# EasyEDA Pro project BlueberryPi.eprj, schematic BlueberryPi Board, sheets 9 to 13 of 13

## Sheets
9 eMMC-GPIO: Page Name: eMMC-GPIO; Update Date: 2023-07-05
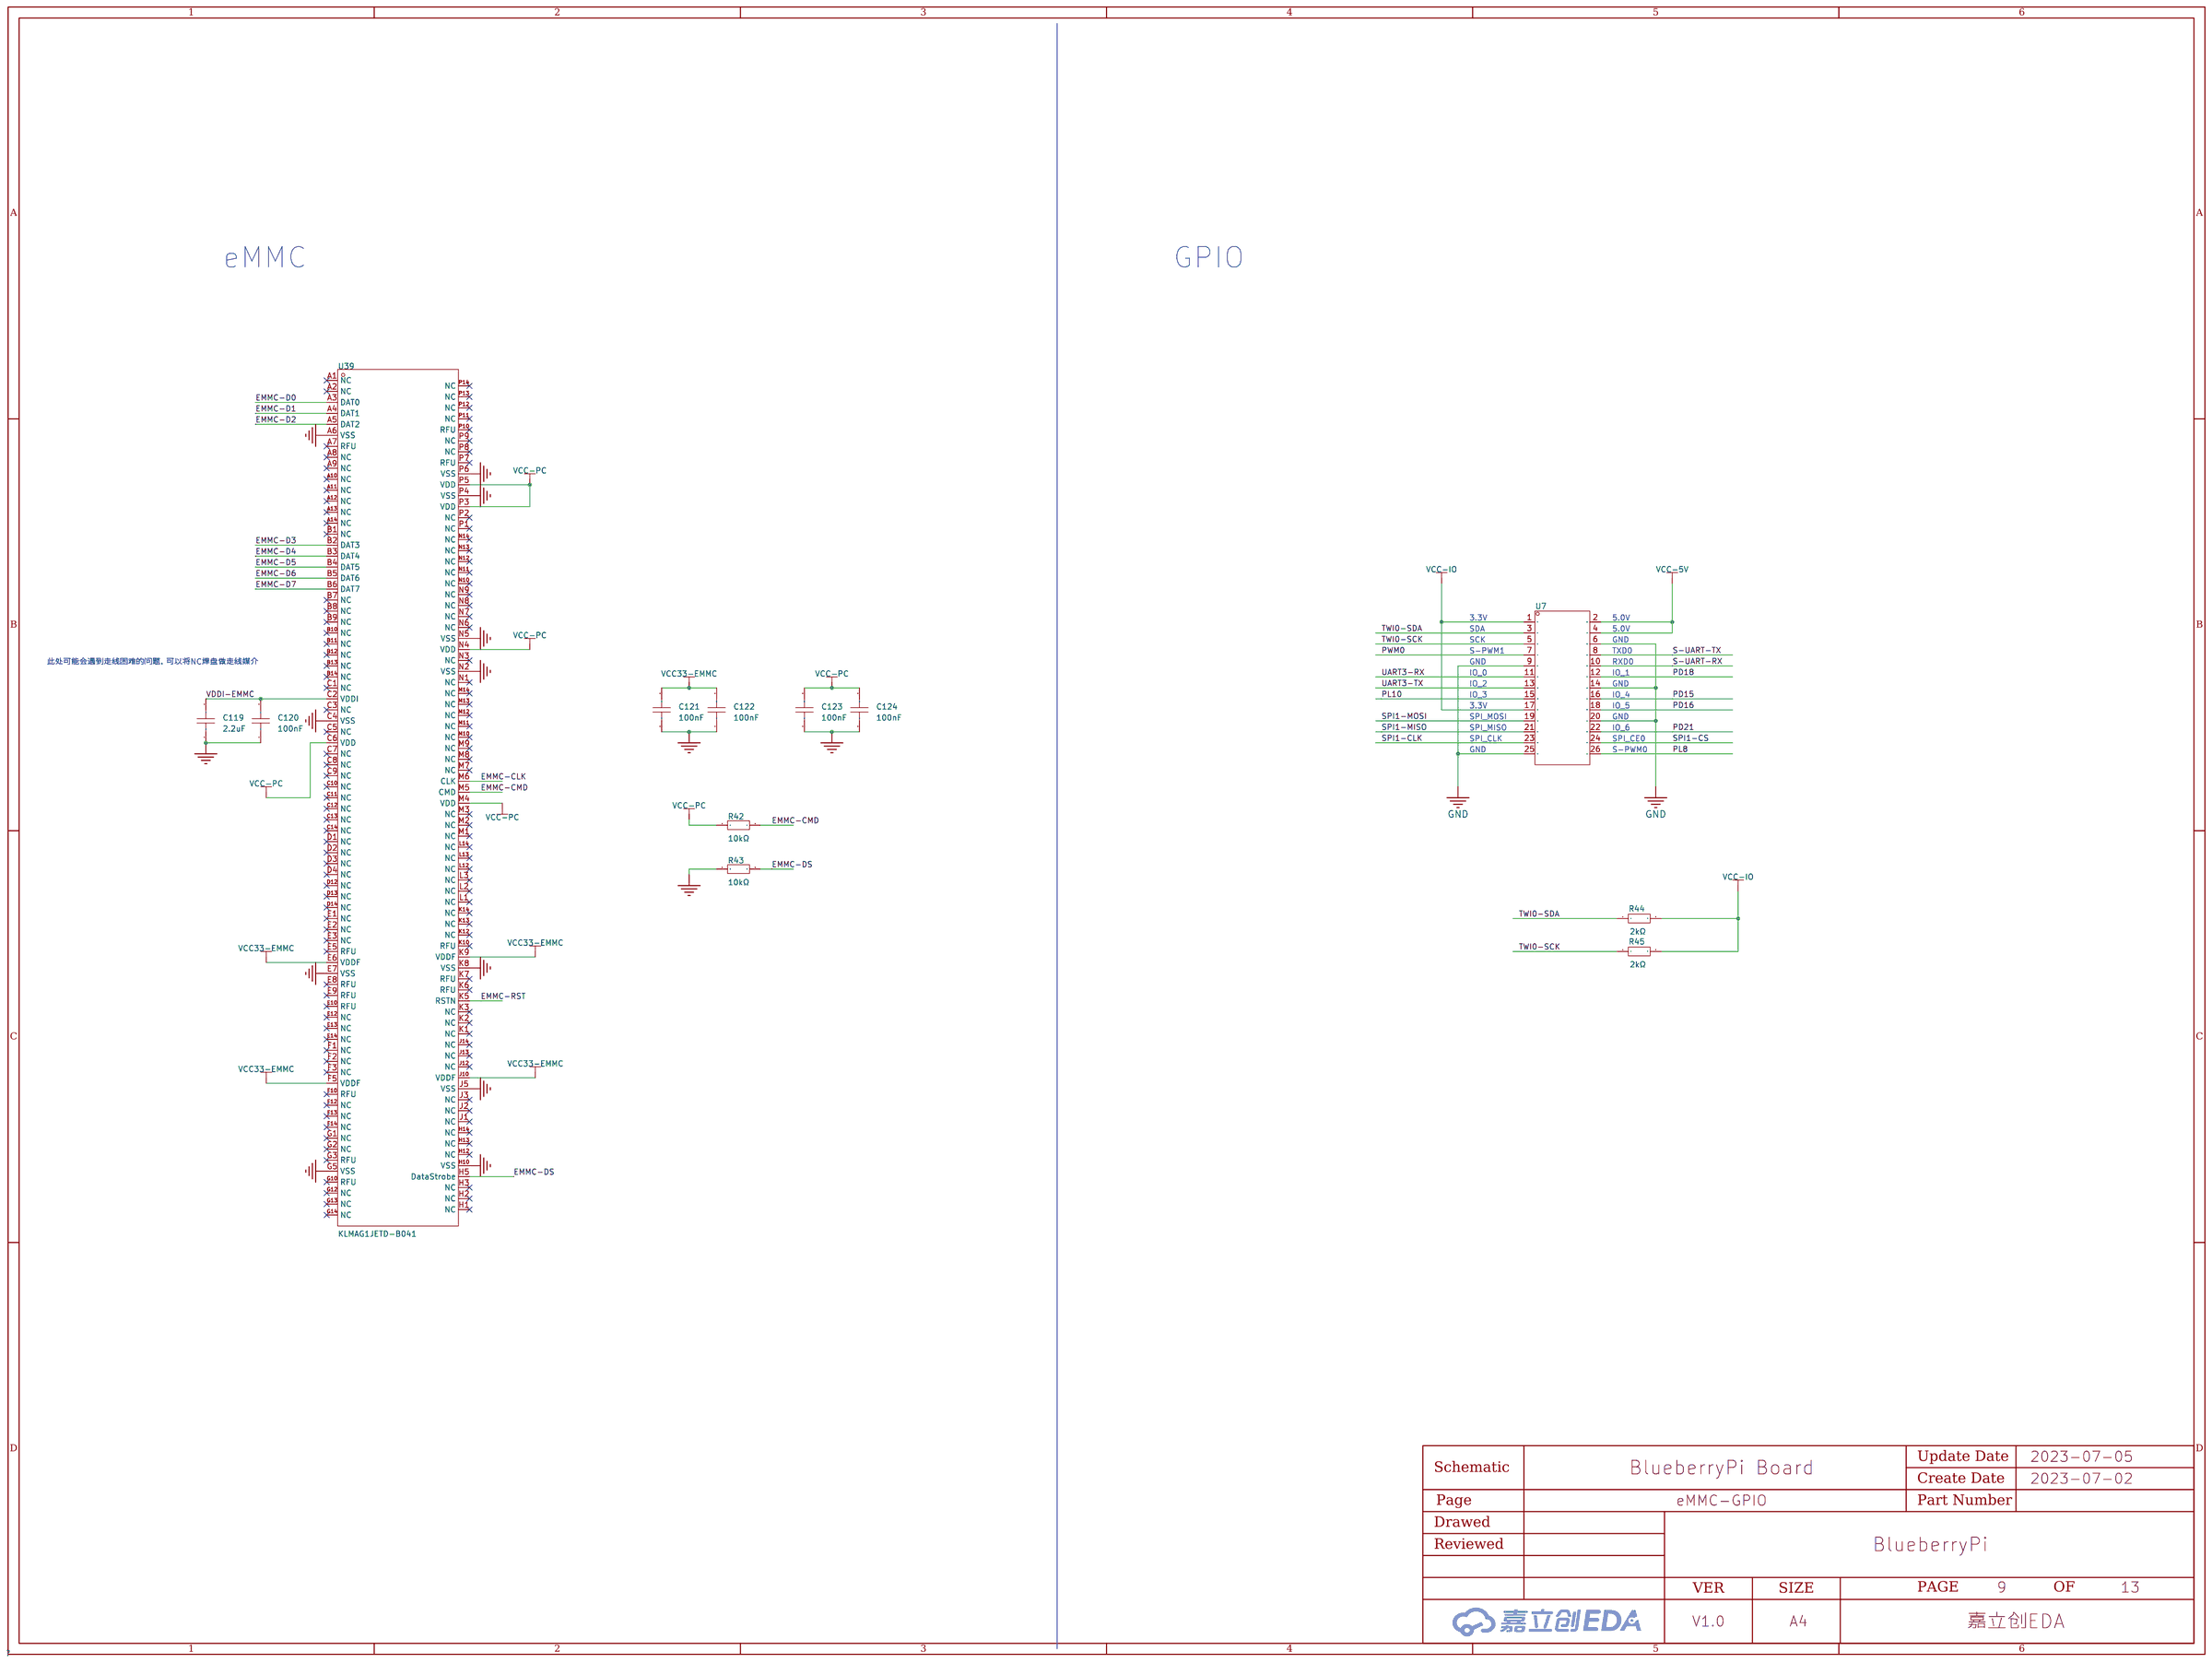
[diagram p8: eMMC-GPIO]
10 CARD-USB: Page Name: CARD-USB; Update Date: 2023-07-06
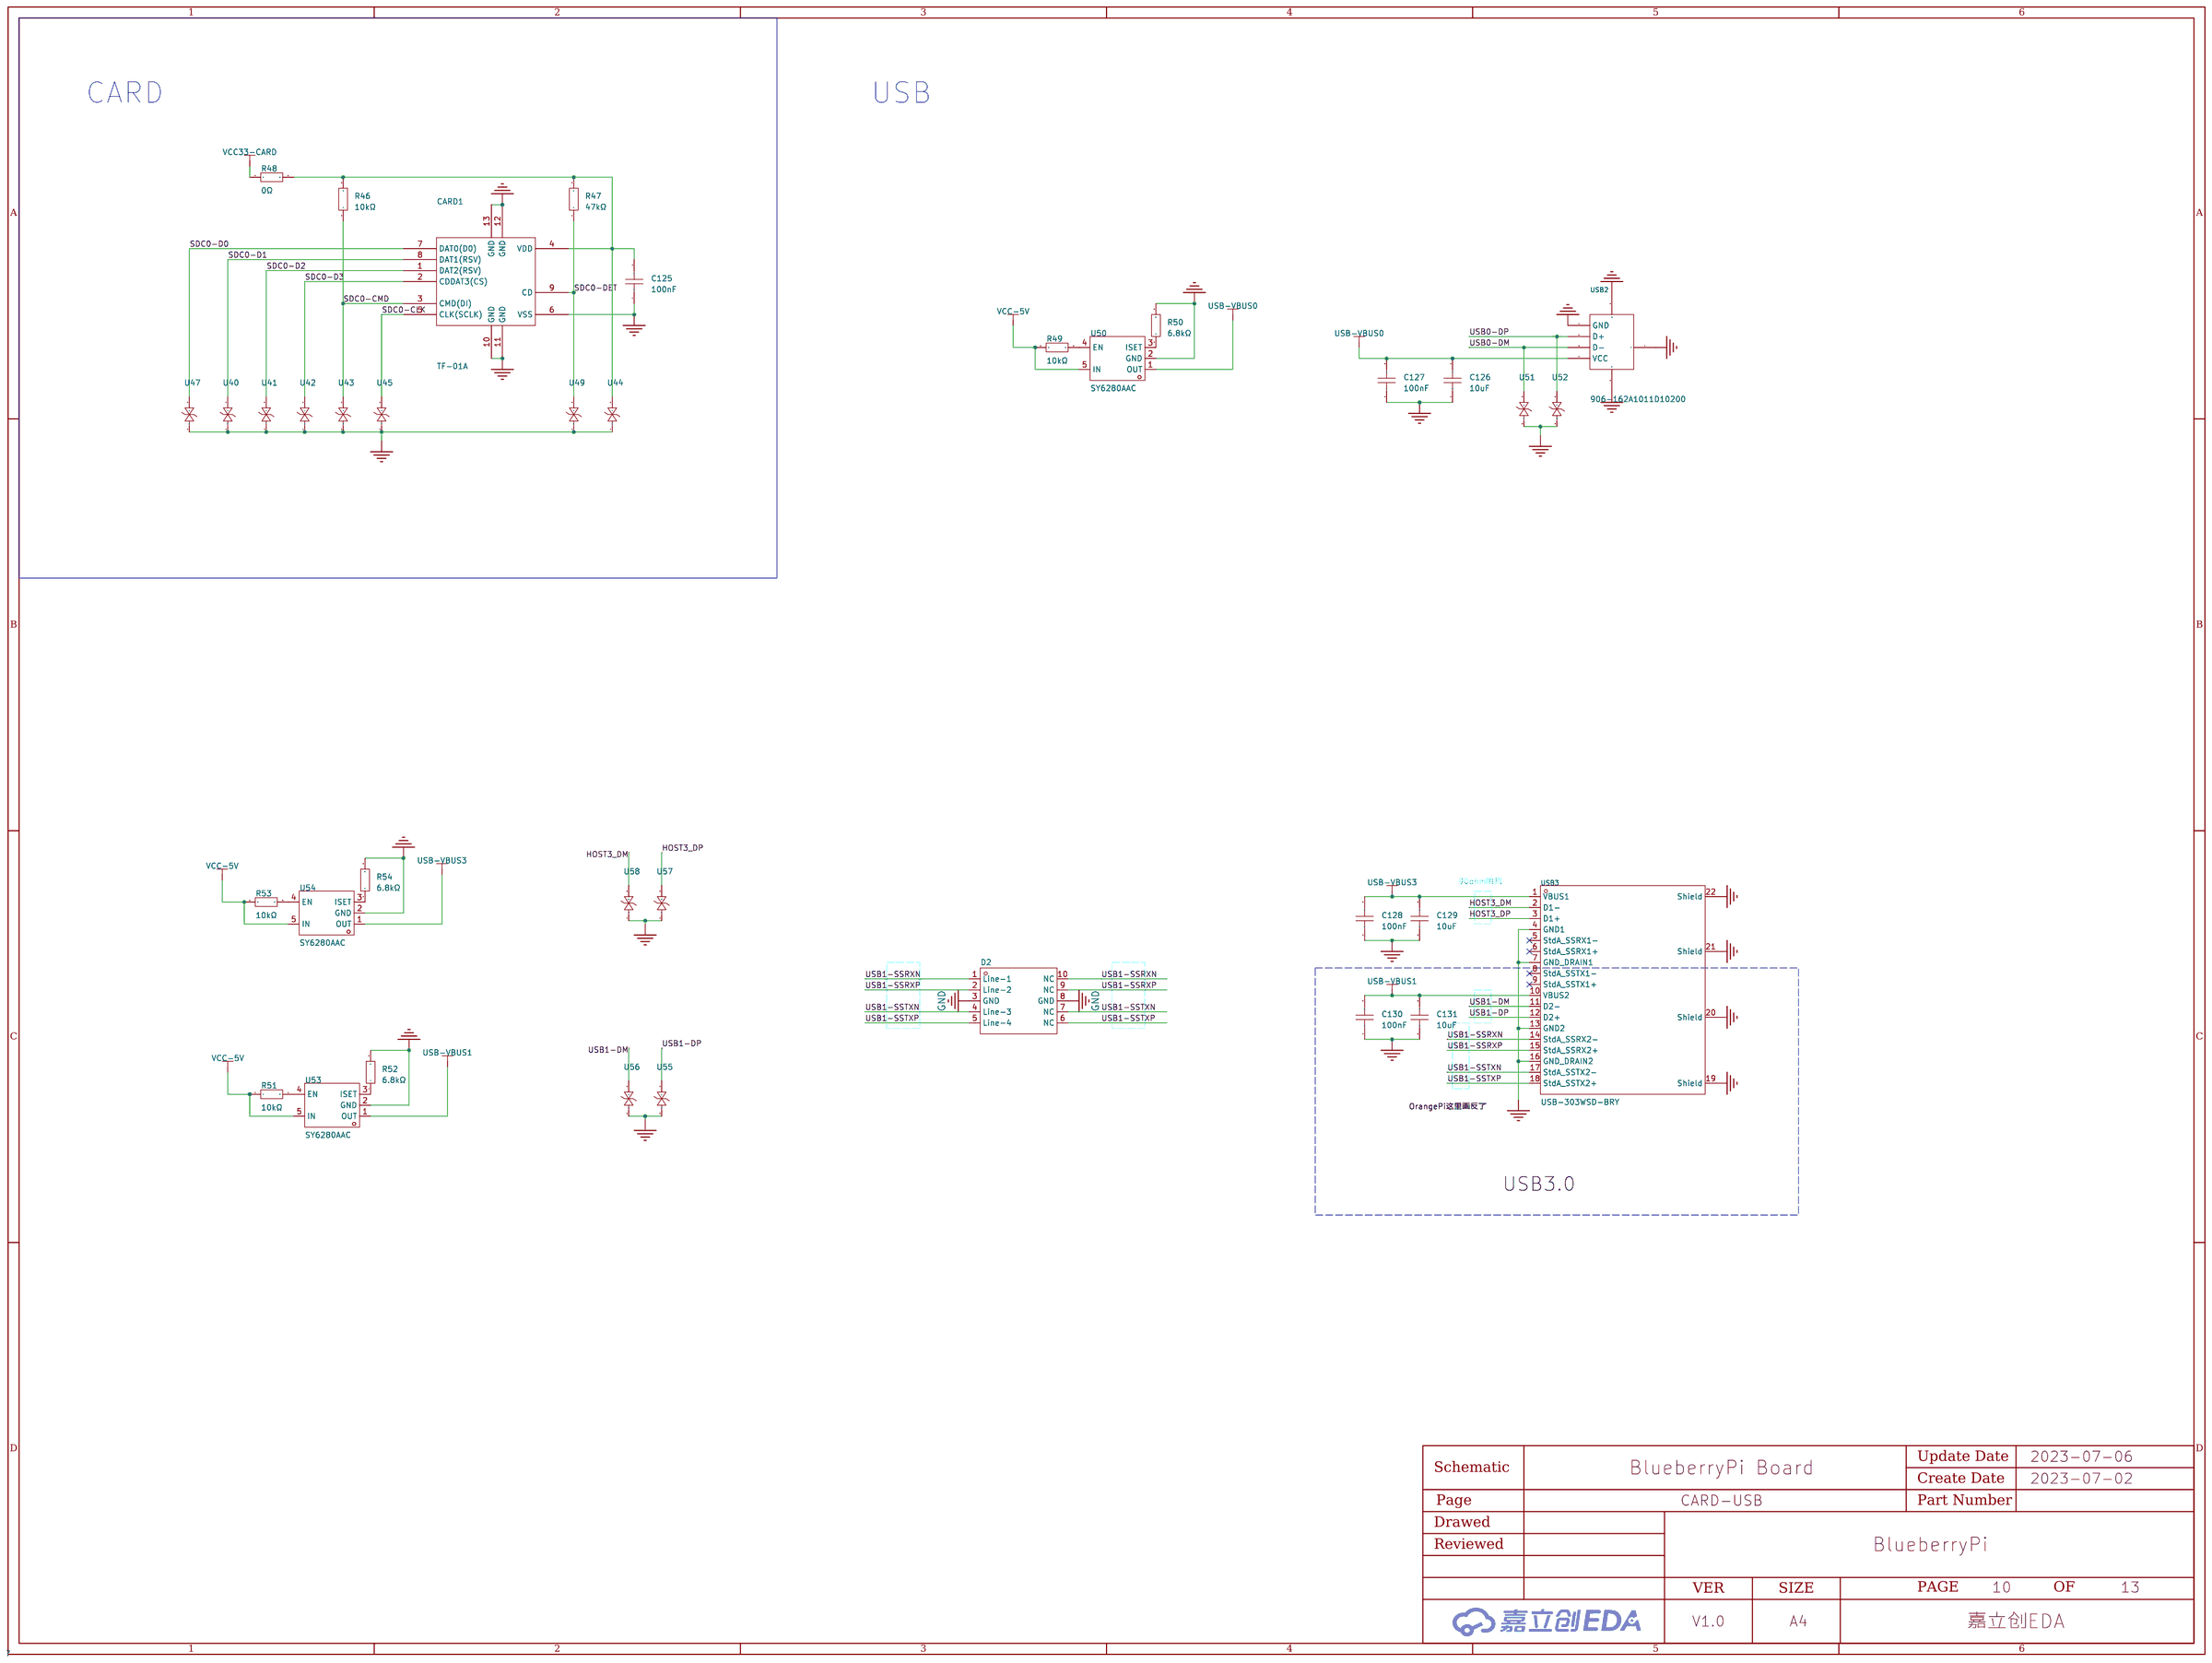
[diagram p9: CARD-USB]
11 KEY-LED-DEBUG: Page Name: KEY-LED-DEBUG; Update Date: 2023-07-07
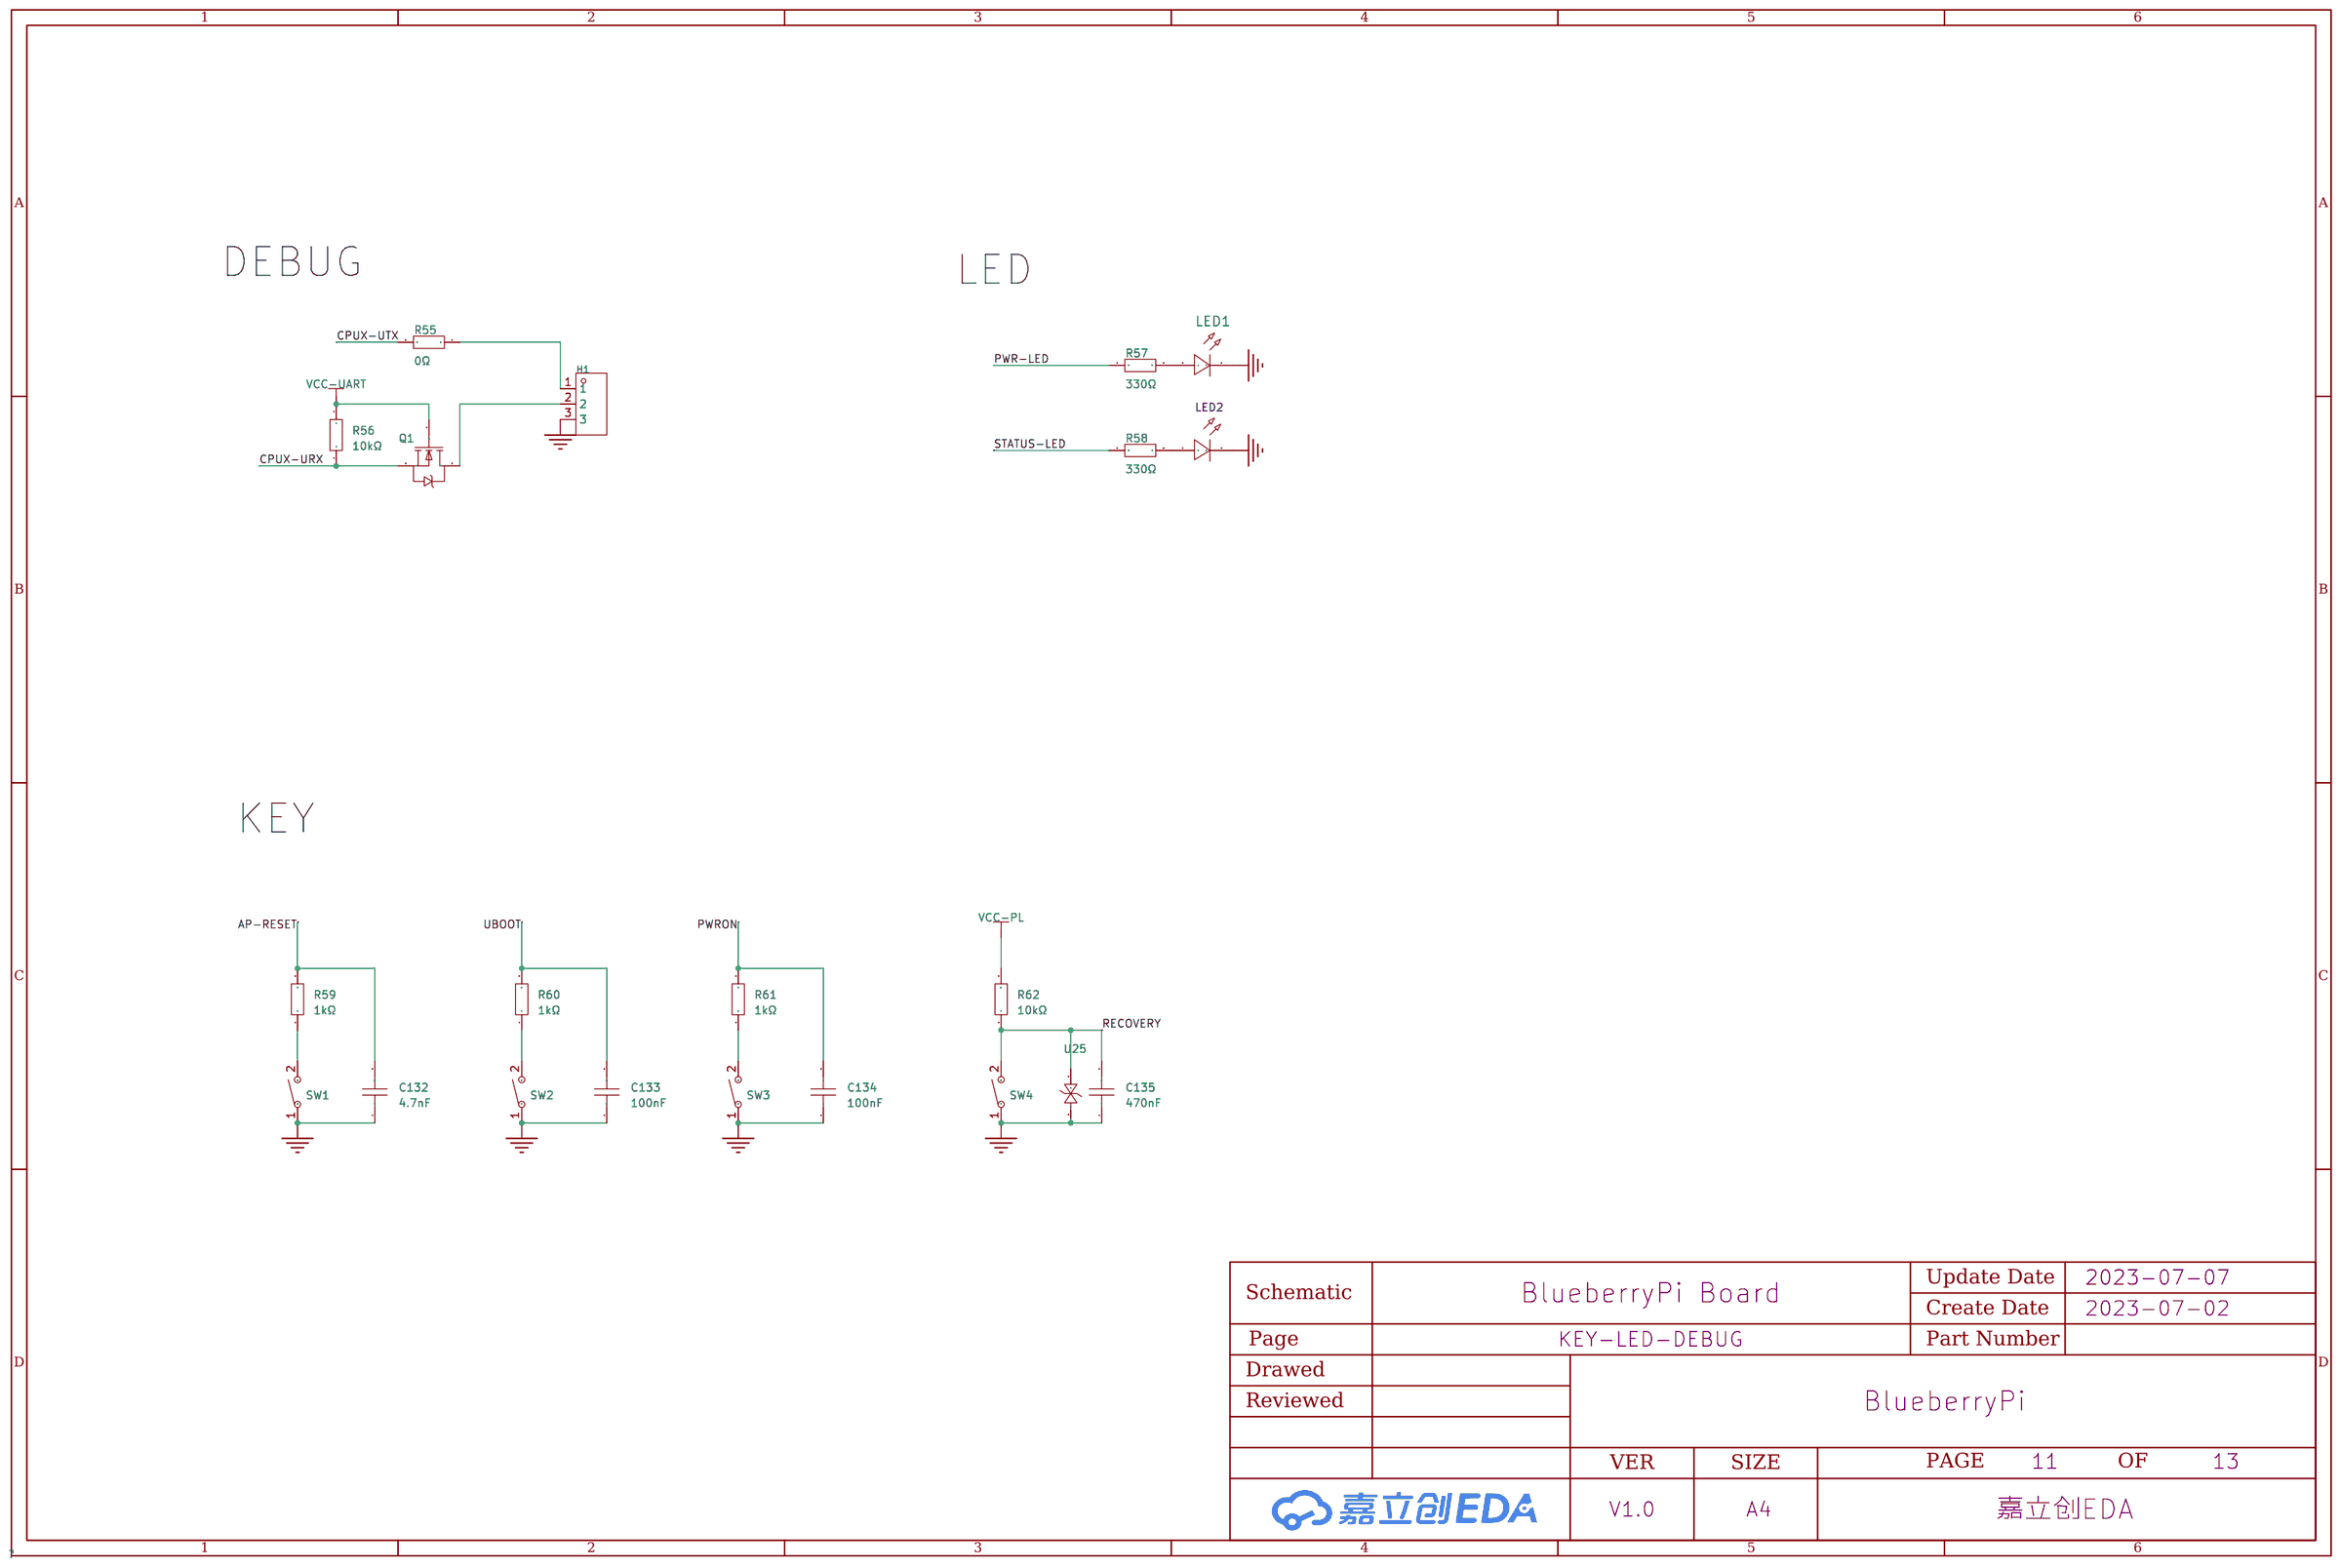
[diagram p10: KEY-LED-DEBUG]
12 AV-HDMI: Page Name: AV-HDMI; Update Date: 2023-09-08
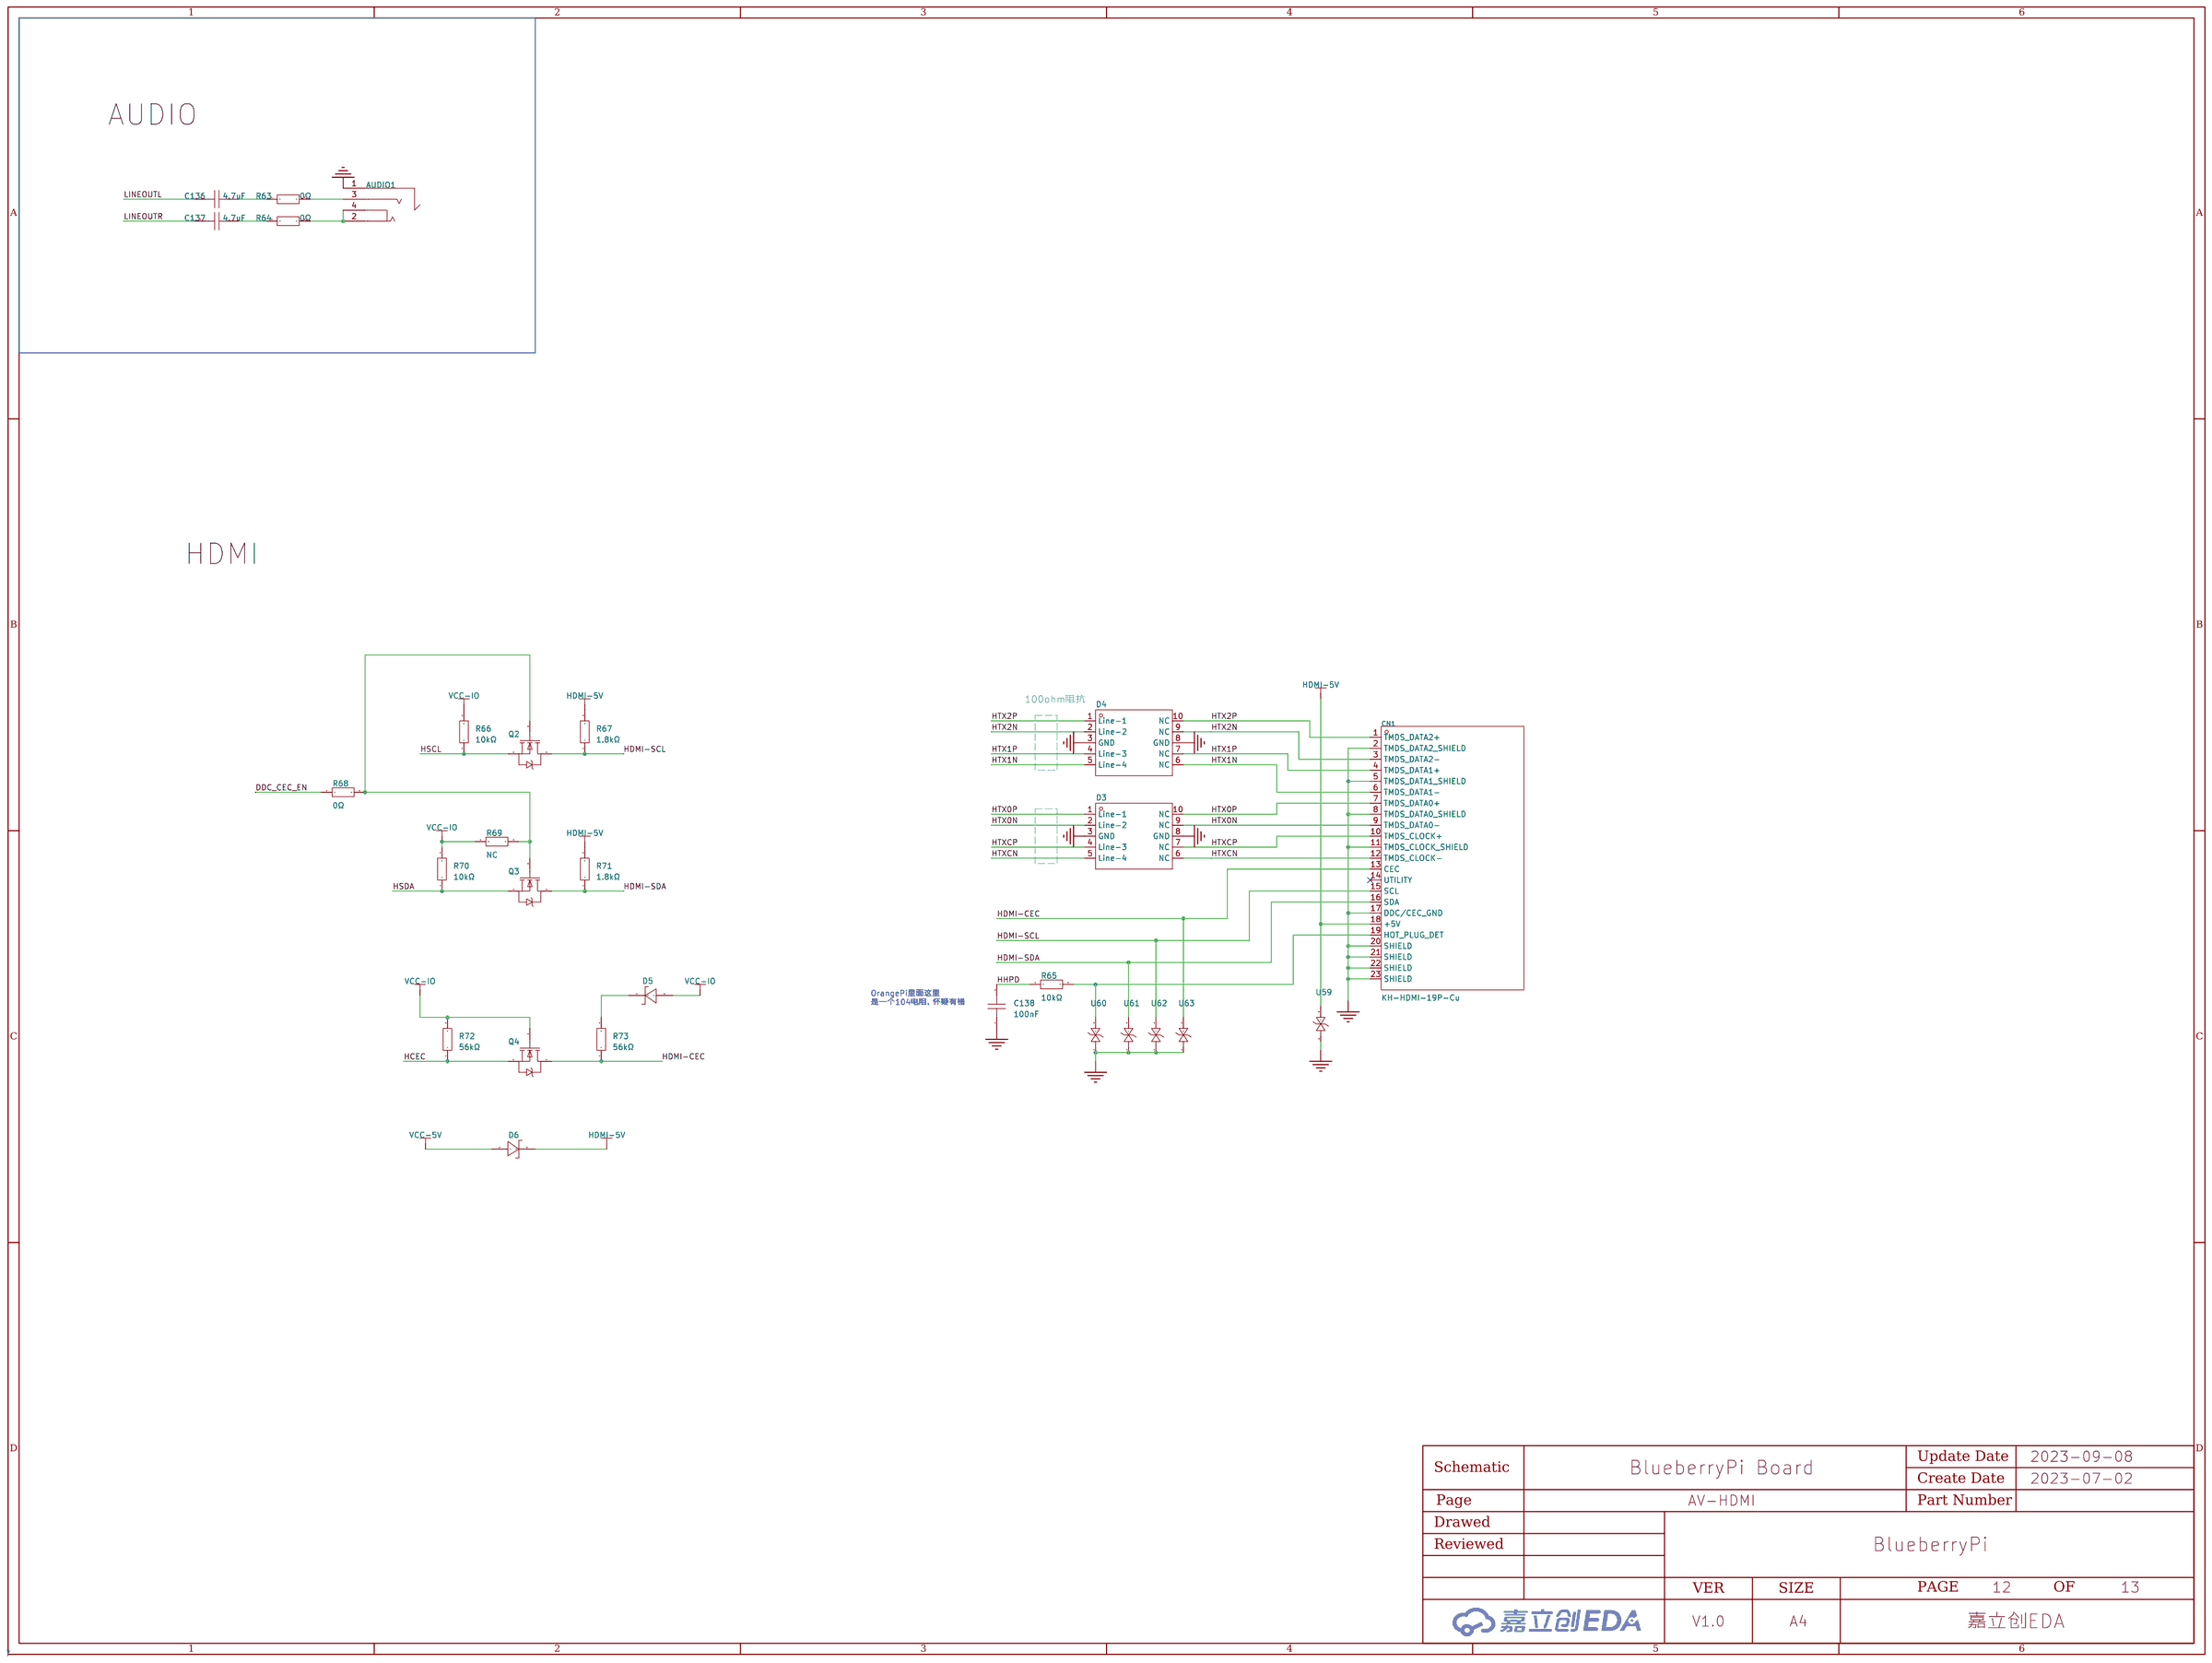
[diagram p11: AV-HDMI]
13 WIFI-BT 1T1R: Page Name: WIFI-BT 1T1R; Update Date: 2023-09-08